# EasyEDA Pro project 效果器12-18.eprj, schematic Schematic1 (continued)
## Sheets (continued)
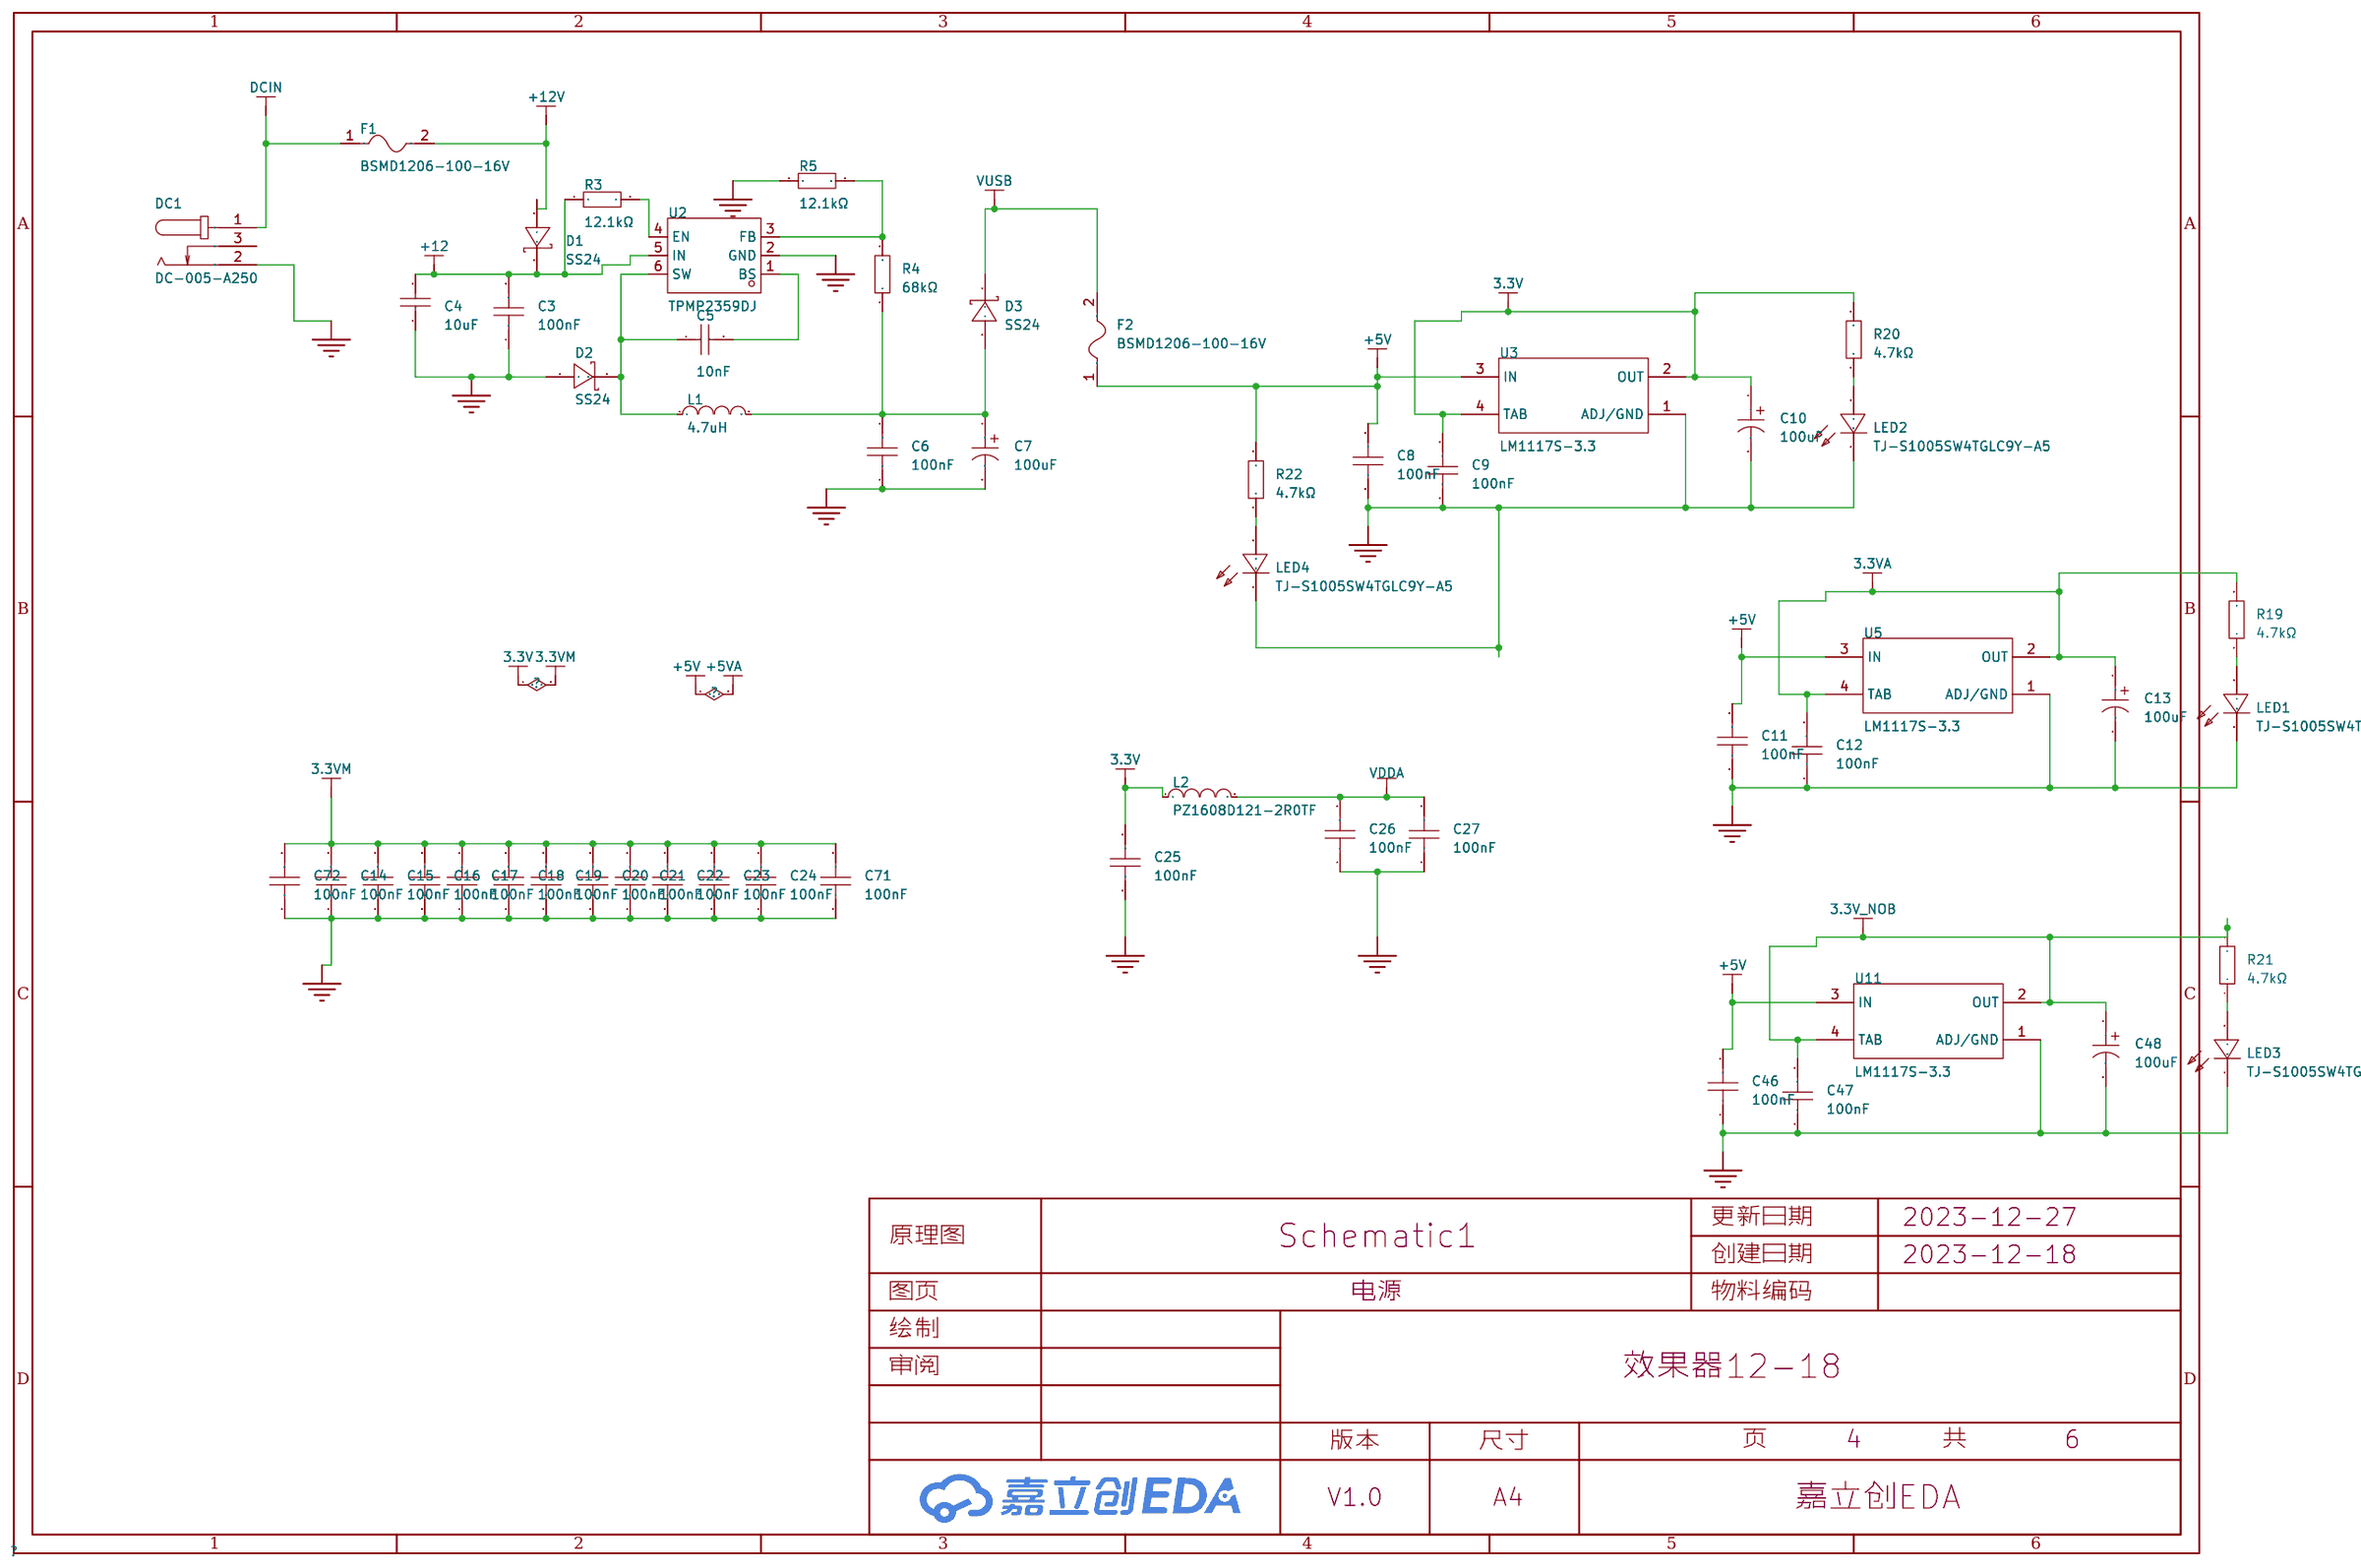
[diagram p3: 电源]
5 ad采集: Page Name: ad采集.Schematic1
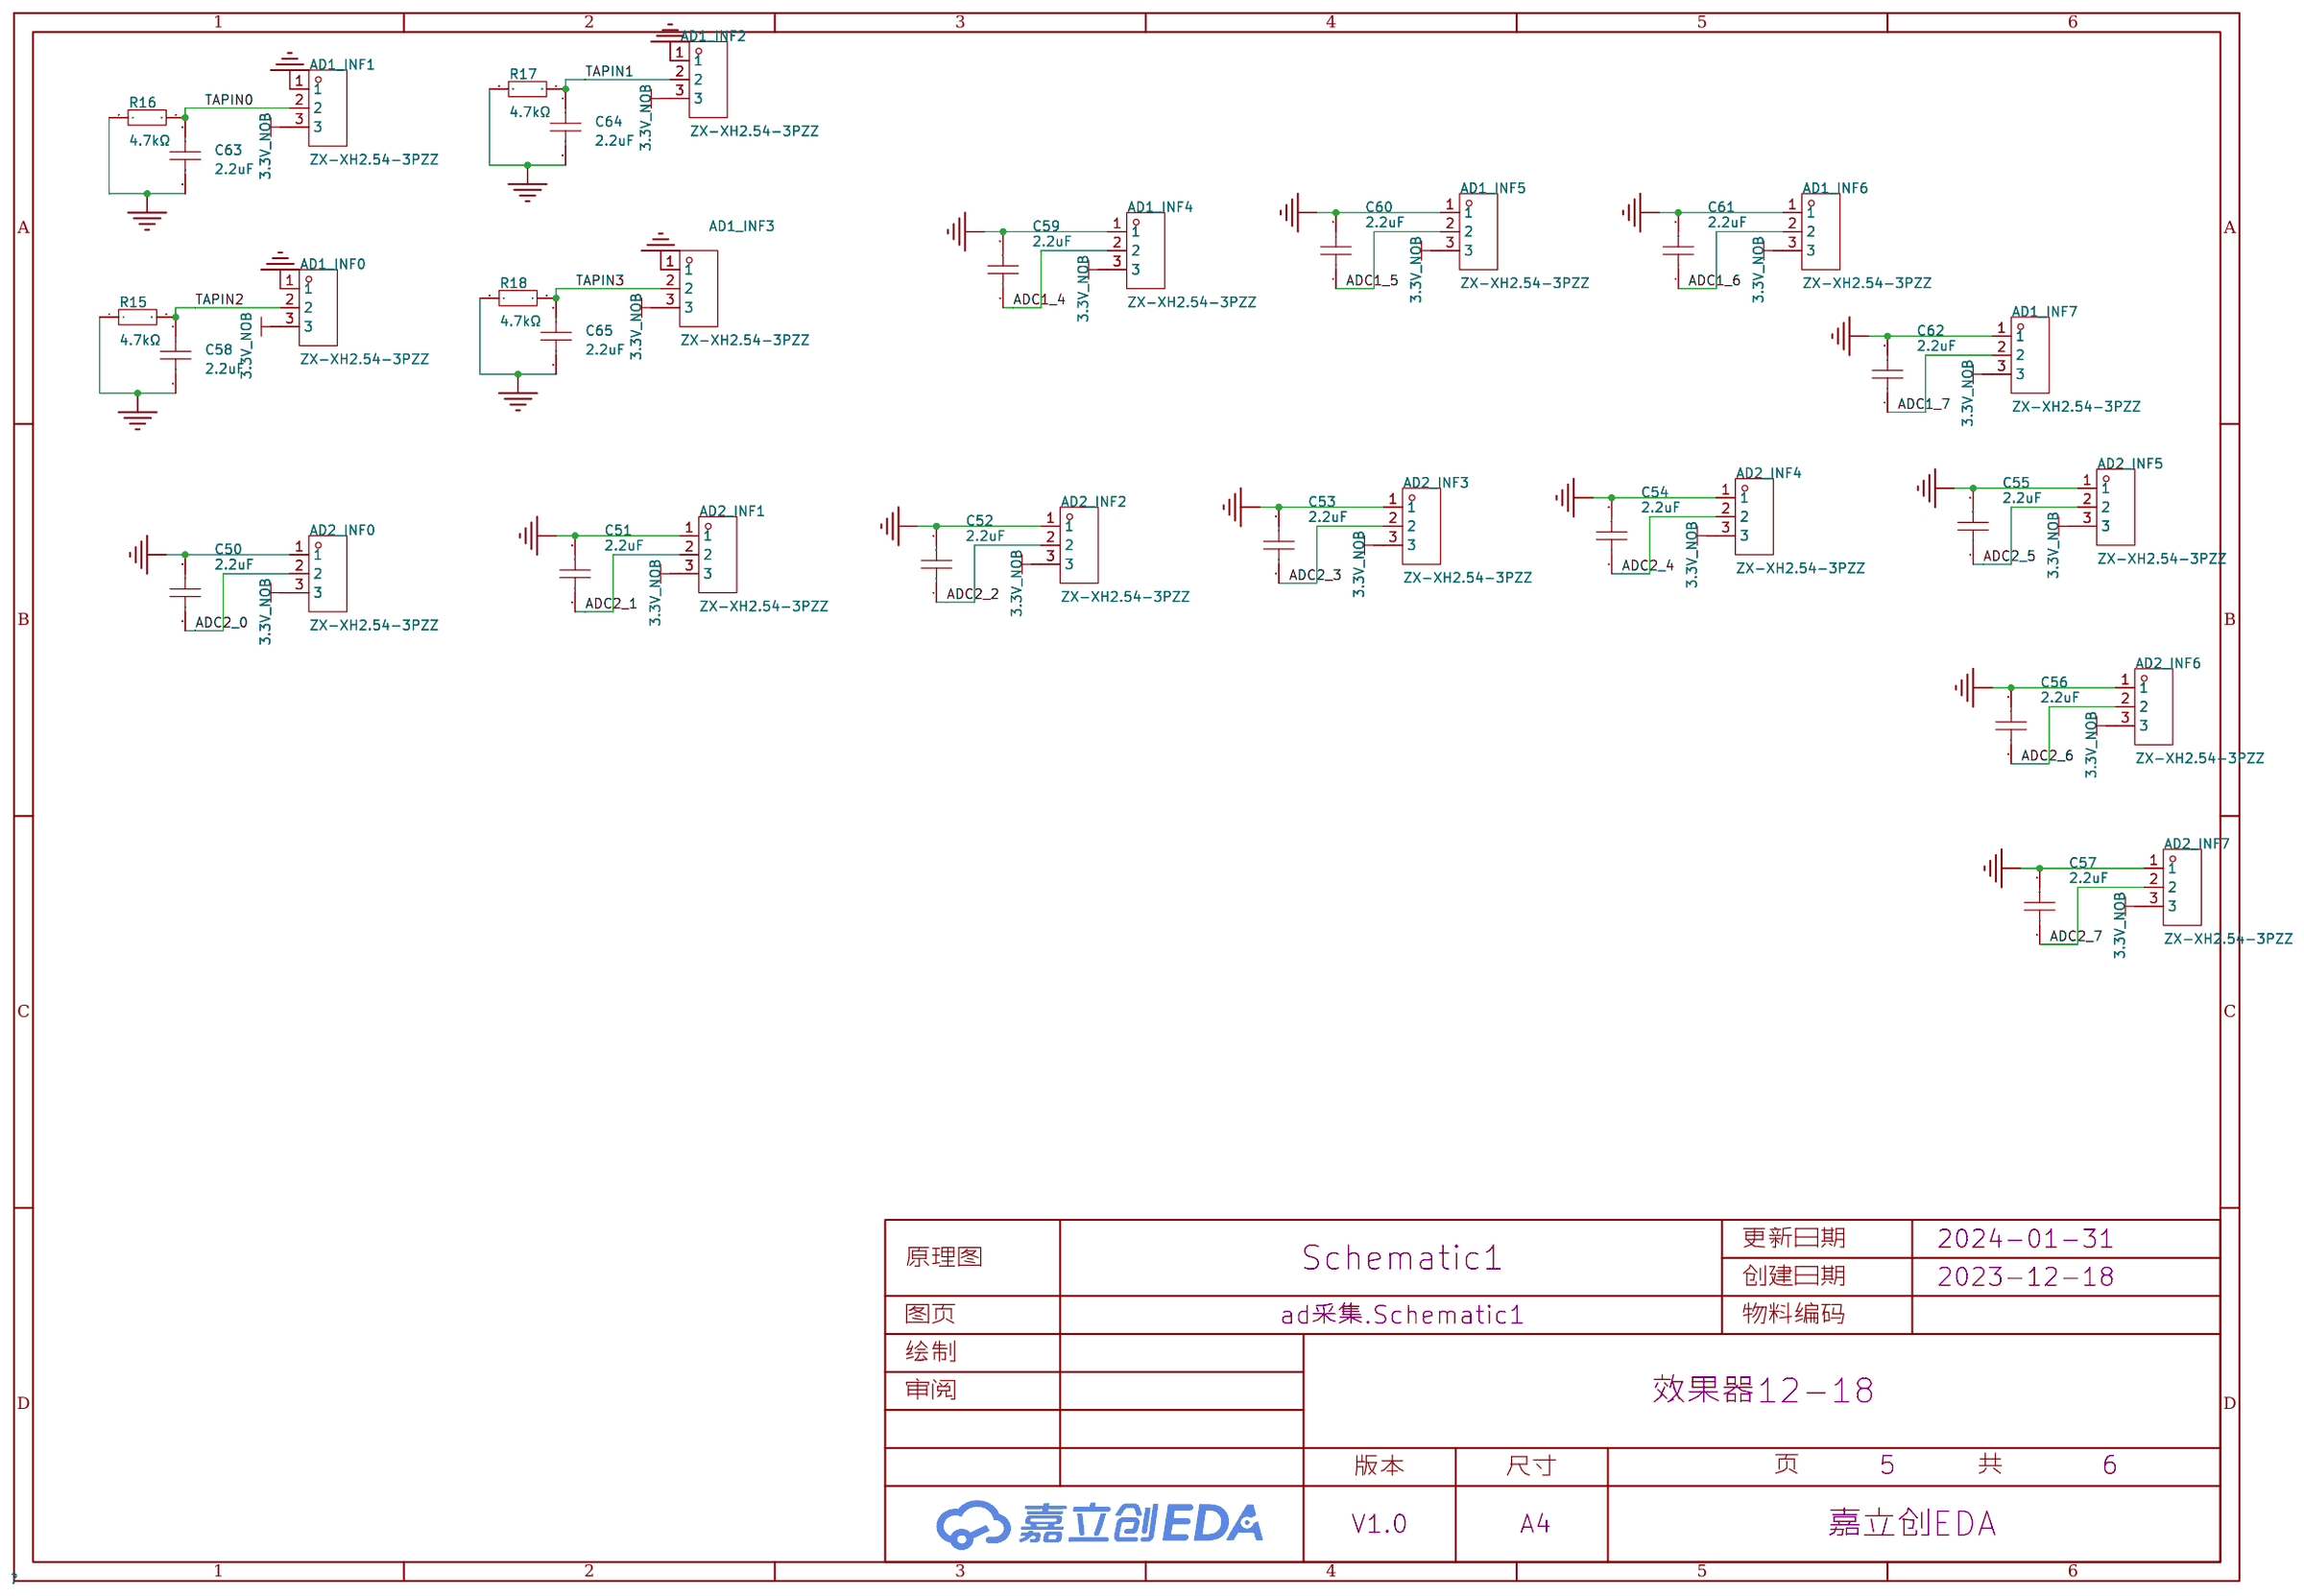
[diagram p4: ad采集]
6 外部接口: Create Date: 2023-12-19; Page Name: 外部接口
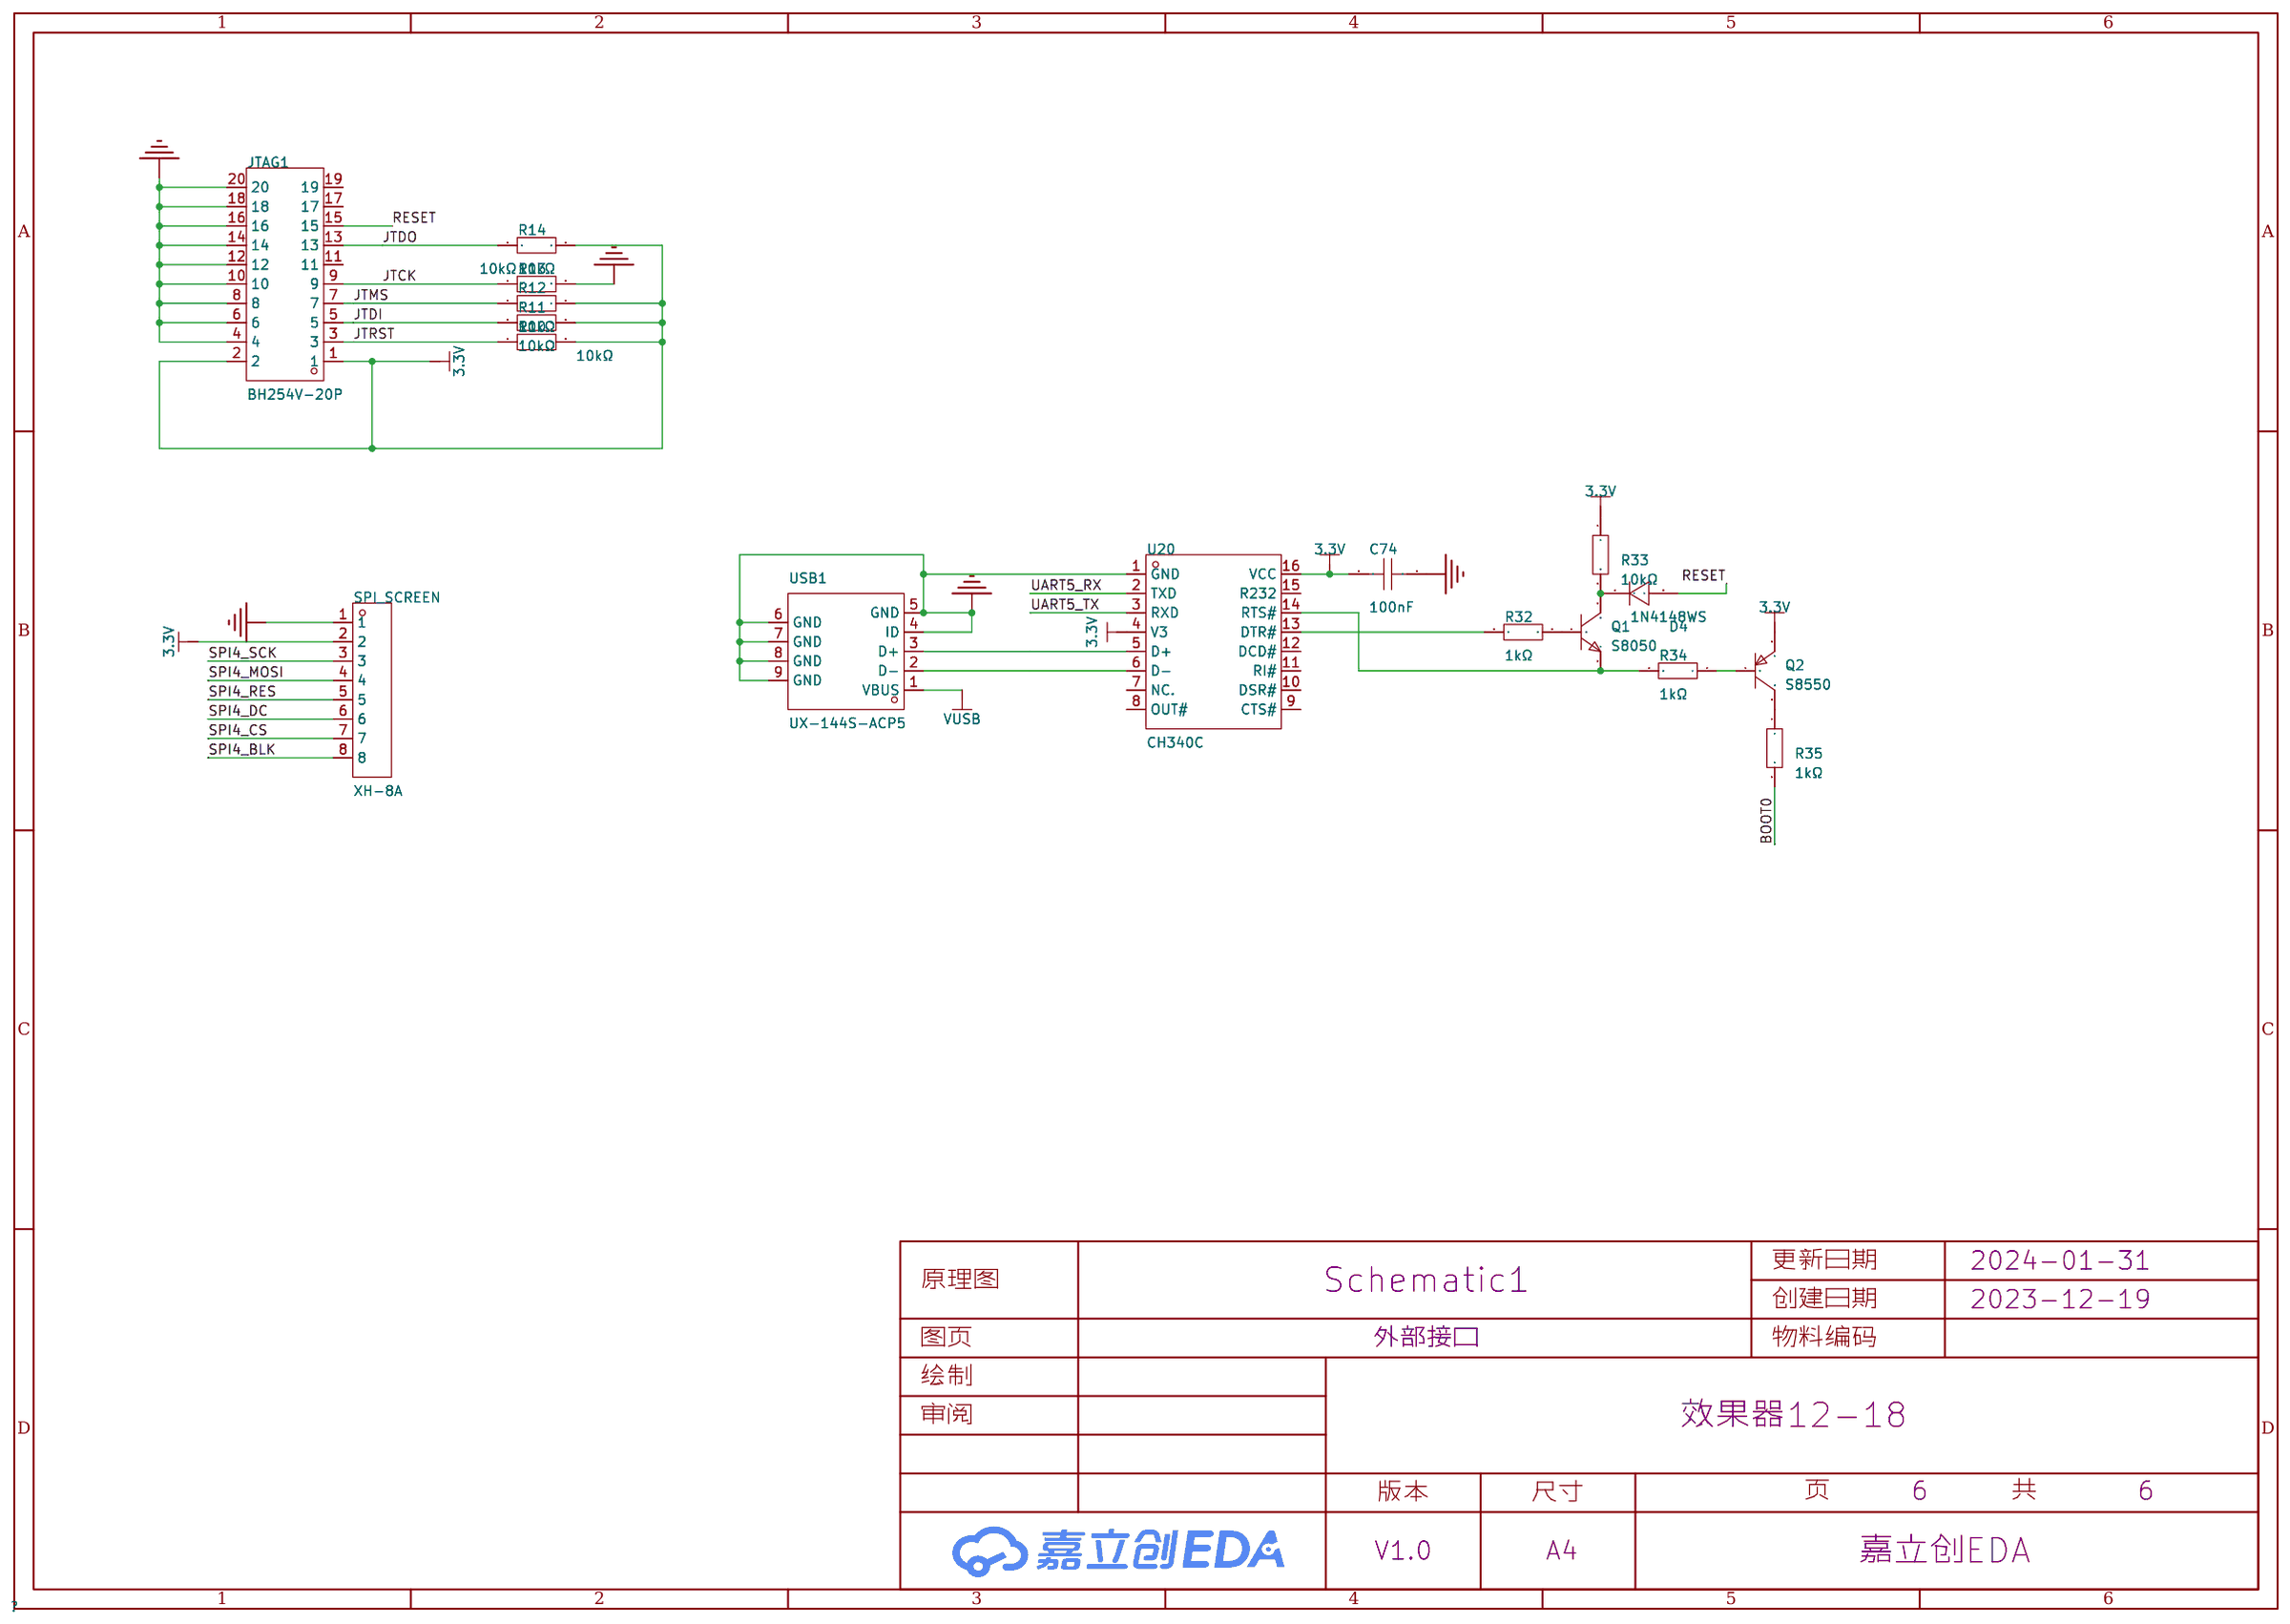
[diagram p5: 外部接口]

## Parts
sheet ad采集
AD1_INF0  ZX-XH2.54-3PZZ  [CONN-TH_3P-P2.54_2501S-3P]
AD1_INF1  ZX-XH2.54-3PZZ  [CONN-TH_3P-P2.54_2501S-3P]
AD1_INF2  ZX-XH2.54-3PZZ  [CONN-TH_3P-P2.54_2501S-3P]
AD1_INF3  ZX-XH2.54-3PZZ  [CONN-TH_3P-P2.54_2501S-3P]
AD1_INF4  ZX-XH2.54-3PZZ  [CONN-TH_3P-P2.54_2501S-3P]
AD1_INF5  ZX-XH2.54-3PZZ  [CONN-TH_3P-P2.54_2501S-3P]
AD1_INF6  ZX-XH2.54-3PZZ  [CONN-TH_3P-P2.54_2501S-3P]
AD1_INF7  ZX-XH2.54-3PZZ  [CONN-TH_3P-P2.54_2501S-3P]
AD2_INF0  ZX-XH2.54-3PZZ  [CONN-TH_3P-P2.54_2501S-3P]
AD2_INF1  ZX-XH2.54-3PZZ  [CONN-TH_3P-P2.54_2501S-3P]
AD2_INF2  ZX-XH2.54-3PZZ  [CONN-TH_3P-P2.54_2501S-3P]
AD2_INF3  ZX-XH2.54-3PZZ  [CONN-TH_3P-P2.54_2501S-3P]
AD2_INF4  ZX-XH2.54-3PZZ  [CONN-TH_3P-P2.54_2501S-3P]
AD2_INF5  ZX-XH2.54-3PZZ  [CONN-TH_3P-P2.54_2501S-3P]
AD2_INF6  ZX-XH2.54-3PZZ  [CONN-TH_3P-P2.54_2501S-3P]
AD2_INF7  ZX-XH2.54-3PZZ  [CONN-TH_3P-P2.54_2501S-3P]
C50  2.2uF  [C0402]
C51  2.2uF  [C0402]
C52  2.2uF  [C0402]
C53  2.2uF  [C0402]
C54  2.2uF  [C0402]
C55  2.2uF  [C0402]
C56  2.2uF  [C0402]
C57  2.2uF  [C0402]
C58  2.2uF  [C0402]
C59  2.2uF  [C0402]
C60  2.2uF  [C0402]
C61  2.2uF  [C0402]
C62  2.2uF  [C0402]
C63  2.2uF  [C0402]
C64  2.2uF  [C0402]
C65  2.2uF  [C0402]
R15  4.7kΩ  [R0603]
R16  4.7kΩ  [R0603]
R17  4.7kΩ  [R0603]
R18  4.7kΩ  [R0603]
sheet stm32部分
C1  10pF  [C0402]
C2  10pF  [C0402]
C66  2.2uF  [C0402]
C67  2.2uF  [C0402]
C68  20pF  [C0402]
C69  20pF  [C0402]
C70  100nF  [C0402]
H1  PZ254V-12-20P  [HDR-TH_20P-P2.54-V-M-R2-C10-S2.54]
H2  PZ254V-12-20P  [HDR-TH_20P-P2.54-V-M-R2-C10-S2.54]
H3  PZ254V-12-20P  [HDR-TH_20P-P2.54-V-M-R2-C10-S2.54]
H4  PZ254V-12-20P  [HDR-TH_20P-P2.54-V-M-R2-C10-S2.54]
LED5  NCD0805R1  [LED0805-R-RD]
LED6  NCD0805R1  [LED0805-R-RD]
LED7  NCD0805R1  [LED0805-R-RD]
LED8  NCD0805R1  [LED0805-R-RD]
LED9  NCD0805R1  [LED0805-R-RD]
R2  10kΩ  [R0603]
R23  10kΩ  [R0603]
R24  0Ω  [R0805]
R25  10kΩ  [R0603]
R26  1kΩ  [R0603]
R27  1kΩ  [R0603]
R28  1kΩ  [R0603]
R29  1kΩ  [R0603]
R30  1kΩ  [R0603]
R31  30Ω  [R0402]
SW1  TS-1101-C-W  [SW-SMD_L6.0-W3.3-LS8.0]
U8  STM32H743ZIT6  [LQFP-144_L20.0-W20.0-P0.50-LS22.0-BL]
U14  32.768kHz  [CRYSTAL-SMD_L2.0-W1.2]
X1  24MHz  [OSC-SMD_4P-L3.2-W2.5-BL]
sheet 外部接口
C74  100nF  [C0402]
D4  1N4148WS  [SOD-323_L1.8-W1.3-LS2.5-RD]
JTAG1  BH254V-20P  [CONN-TH_20P-P2.54_0702462001]
Q1  S8050  [SOT-23-3_L2.9-W1.3-P1.90-LS2.4-BR]
Q2  S8550  [SOT-23-3_L2.9-W1.3-P1.90-LS2.4-BR]
R10  10kΩ  [R0603]
R11  10kΩ  [R0603]
R12  10kΩ  [R0603]
R13  10kΩ  [R0603]
R14  10kΩ  [R0603]
R32  1kΩ  [R0603]
R33  10kΩ  [R0603]
R34  1kΩ  [R0603]
R35  1kΩ  [R0603]
SPI_SCREEN  XH-8A  [CONN-TH_8P-P2.50_HCTL_XH-8A_C2908606]
U20  CH340C  [SOP-16_L10.0-W3.9-P1.27-LS6.0-BL]
USB1  UX-144S-ACP5  [MINI-USB-SMD_UX-144S-ACP5]
sheet 电源
C3  100nF  [C0603]
C4  10uF  [C0805]
C5  10nF  [C0805]
C6  100nF  [C0402]
C7  100uF  [CAP-SMD_BD6.3-L6.6-W6.6-FD]
C8  100nF  [C0402]
C9  100nF  [C0402]
C10  100uF  [CAP-SMD_BD6.3-L6.6-W6.6-FD]
C11  100nF  [C0402]
C12  100nF  [C0402]
C13  100uF  [CAP-SMD_BD6.3-L6.6-W6.6-FD]
C14  100nF  [C0402]
C15  100nF  [C0402]
C16  100nF  [C0402]
C17  100nF  [C0402]
C18  100nF  [C0402]
C19  100nF  [C0402]
C20  100nF  [C0402]
C21  100nF  [C0402]
C22  100nF  [C0402]
C23  100nF  [C0402]
C24  100nF  [C0402]
C25  100nF  [C0402]
C26  100nF  [C0402]
C27  100nF  [C0402]
C46  100nF  [C0402]
C47  100nF  [C0402]
C48  100uF  [CAP-SMD_BD6.3-L6.6-W6.6-FD]
C71  100nF  [C0402]
C72  100nF  [C0402]
D1  SS24  [SMA_L4.3-W2.6-LS5.2-RD]
D2  SS24  [SMA_L4.3-W2.6-LS5.2-RD]
D3  SS24  [SMA_L4.3-W2.6-LS5.2-RD]
DC1  DC-005-A250  [DC-IN-TH_DC-005-A250]
F1  BSMD1206-100-16V  [F1206]
F2  BSMD1206-100-16V  [F1206]
L1  4.7uH  [IND-SMD_L3.5-W3.0]
L2  PZ1608D121-2R0TF  [L0603]
LED1  TJ-S1005SW4TGLC9Y-A5  [LED0402-RD_YELLOW]
LED2  TJ-S1005SW4TGLC9Y-A5  [LED0402-RD_YELLOW]
LED3  TJ-S1005SW4TGLC9Y-A5  [LED0402-RD_YELLOW]
LED4  TJ-S1005SW4TGLC9Y-A5  [LED0402-RD_YELLOW]
R3  12.1kΩ  [R0805]
R4  68kΩ  [R0805]
R5  12.1kΩ  [R0805]
R19  4.7kΩ  [R0603]
R20  4.7kΩ  [R0603]
R21  4.7kΩ  [R0603]
R22  4.7kΩ  [R0603]
U2  TPMP2359DJ  [SOT-23-6_L2.9-W1.6-P0.95-LS2.8-BL]
U3  LM1117S-3.3  [SOT-223-3_L6.5-W3.4-P2.30-LS7.0-BR]
U5  LM1117S-3.3  [SOT-223-3_L6.5-W3.4-P2.30-LS7.0-BR]
U11  LM1117S-3.3  [SOT-223-3_L6.5-W3.4-P2.30-LS7.0-BR]
sheet 音频外设
C28  10uF  [C0603]
C29  100nF  [C0402]
C30  10uF  [C0603]
C31  100uF  [CAP-SMD_BD6.3-L6.6-W6.6-FD]
C32  100uF  [CAP-SMD_BD6.3-L6.6-W6.6-FD]
C33  10uF  [C0603]
C34  100nF  [C0402]
C35  10uF  [C0603]
C36  100nF  [C0402]
C37  1uF  [C0402]
C38  1uF  [C0402]
C75  1uF  [C0402]
C76  1uF  [C0402]
CN1  PJ-313D  [AUDIO-SMD_PJ-313D-2]
LINEIN1  ZX-XH2.54-3PZZ  [CONN-TH_3P-P2.54_2501S-3P]
LINEOUT1  ZX-XH2.54-3PZZ  [CONN-TH_3P-P2.54_2501S-3P]
R6  0Ω  [R0805]
R7  10Ω  [R0603]
R8  10kΩ  [R0603]
R36  1MΩ  [R1206]
R37  1MΩ  [R1206]
R38  1MΩ  [R1206]
R39  1MΩ  [R1206]
R41  100Ω  [R0603]
R42  100Ω  [R0603]
TEST_PIN  PZ127V-11-08-H25  [HDR-TH_8P-P1.27_PZ127V-11-08-H25]
U6  WM8978CGEFL/RV  [WQFN-32_L5.0-W5.0-P0.50-TL-EP]
U21  SMTSO3050CTJ  [SMD_SMTSO3060CTJ]
U22  SMTSO3050CTJ  [SMD_SMTSO3060CTJ]
U23  SMTSO3050CTJ  [SMD_SMTSO3060CTJ]
U24  SMTSO3050CTJ  [SMD_SMTSO3060CTJ]

## Library data of the parts
AD1_INF0-AD1_INF7 AD2_INF0-AD2_INF7 = ZX-XH2.54-3PZZ: 插针结构:1x3P;间距:2.54mm;安装方式:直插;行距:-;总PIN数:3P;排数:1;每排PIN数:3;参考系列:XH;额定电流:3A;触头材质:黄铜;触头镀层:锡;工作温度范围:-25℃~+85℃;; LCSC Part Name: 1x3P 间距:2.54mm 直插 系列:XH; Supplier Part: C7429633; Manufacturer: Megastar(兆星); Supplier Footprint: 插件,P=2.54mm; JLCPCB Part Class: Extended Part; Datasheet: https://atta.szlcsc.com/upload/public/pdf/source/20230619/AE17037A2CFDBE8D9CBA775D61AD0A84.pdf; Supplier: LCSC; Pins Structure: 1x3P; Pitch: 2.54mm; Mounting Style: 直插; Number of Pins: 3P; Number of Rows: 1; Number of PINs Per Row: 3; Reference Series: XH; Current Rating (Max): 3A; Contact Material: 黄铜; Contact Plating: 锡; Operating Temperature Range: -25℃~+85℃; Check: true
C50-C67 = GRM155R61A225KE95D: 容值:2.2uF;精度:±10%;额定电压:10V;材质(温度系数):X5R;; LCSC Part Name: 2.2uF ±10% 10V; Supplier Part: C77002; Manufacturer: muRata(村田); Supplier Footprint: 0402; JLCPCB Part Class: Extended Part; Datasheet: https://atta.szlcsc.com/upload/public/pdf/source/20180326/C77002_D35CAAF23EAD1FF71F41A67C7E29E1B2.pdf; Supplier: LCSC; Tolerance: ±10%; Voltage Rated: 10V; Temperature Coefficient: X5R; Check: true
R15-R22 = 0603WAF4701T5E: 阻值:4.7kΩ;精度:±1%;功率:100mW;温度系数:±100ppm/℃;电阻类型:厚膜电阻;; LCSC Part Name: 4.7kΩ ±1% 100mW 厚膜电阻; Supplier Part: C23162; Manufacturer: UNI-ROYAL(厚声); Supplier Footprint: 0603; JLCPCB Part Class: Basic Part; Datasheet: https://atta.szlcsc.com/upload/public/pdf/source/20200306/C422600_1E6D84923E4A46A82E41ADD87F860B5C.pdf; Supplier: LCSC; Tolerance: ±1%; Power(Watts): 100mW; Overload Voltage (Max): 75V; Temperature Coefficient: ±100ppm/℃; Type: 厚膜电阻; Operating Temperature Range: -55℃~+155℃; Check: true
C1 C2 = GRM1555C1H100JA01D: 容值:10pF;精度:±5%;额定电压:50V;材质(温度系数):C0G;; LCSC Part Name: 10pF ±5% 50V; Supplier Part: C76946; Manufacturer: muRata(村田); Supplier Footprint: 0402; JLCPCB Part Class: Extended Part; Datasheet: https://atta.szlcsc.com/upload/public/pdf/source/20180307/C76946_15204091154331407734.pdf; Supplier: LCSC; Tolerance: ±5%; Voltage Rated: 50V; Temperature Coefficient: C0G; Check: true
C68 C69 = 0402CG200J500NT: 容值:20pF;精度:±5%;额定电压:50V;材质(温度系数):C0G;; LCSC Part Name: 20pF ±5% 50V; Supplier Part: C1554; Manufacturer: FH(风华); Supplier Footprint: 0402; JLCPCB Part Class: Basic Part; Datasheet: https://atta.szlcsc.com/upload/public/pdf/source/20200305/C486355_26A10D38EF8C2A5C37091D0039909270.pdf; Supplier: LCSC; Tolerance: ±5%; Voltage Rated: 50V; Temperature Coefficient: C0G; Check: true
C6 C8 C9 C11 C12 C14-C27 C29 C34 C36 C46 C47 C70-C72 C74 = CC0402KRX7R7BB104: 容值:100nF;精度:±10%;额定电压:16V;材质(温度系数):X7R;; LCSC Part Name: 100nF ±10% 16V; Supplier Part: C60474; Manufacturer: YAGEO(国巨); Supplier Footprint: 0402; JLCPCB Part Class: Extended Part; Datasheet: https://atta.szlcsc.com/upload/public/pdf/source/20211223/9278FD768280B81DDBEF48FA36411A03.pdf; Supplier: LCSC; Tolerance: ±10%; Voltage Rated: 16V; Temperature Coefficient: X7R; Check: true
H1-H4 = PZ254V-12-20P: 插针结构:2x10P;间距:2.54mm;行距:2.54mm;圆针/方针:方针;安装类型:直插;排数:双排;总PIN位数:20P;额定电流:-;额定电压:-;配合针长度:6mm;塑高:2.5mm;端接针长度:3mm;触头材质:黄铜;触头镀层:-;工作温度范围:-40℃~+105℃;颜色:黑色;; LCSC Part Name: 间距:2.54mm 2x10P 直插 方针; Supplier Part: C492427; Manufacturer: XFCN(兴飞); Supplier Footprint: 插件,P=2.54mm; JLCPCB Part Class: 扩展库; Datasheet: https://atta.szlcsc.com/upload/public/pdf/source/20200309/C492427_9411E93D35F2EC20CED9A3ED9F4BBE60.pdf; Supplier: LCSC; Pin Structure: 2x10P; Pitch: 2.54mm; Row Spacing: 2.54mm; Circluar Pins/Square Pins: 方针; Mounting Type: 直插; Number of Rows: 双排; Number of Pins: 20P; Length of Mating Pin: 6mm; Insulation Height: 2.5mm; Length of End Connection Pin: 3mm; Contact Material: 黄铜; Operating Temperature Range: -40℃~+105℃; Color: 黑色